# Altium schematic sheet gateway3.SchDoc
size A3; SheetNumber: 1; SheetTotal: 1
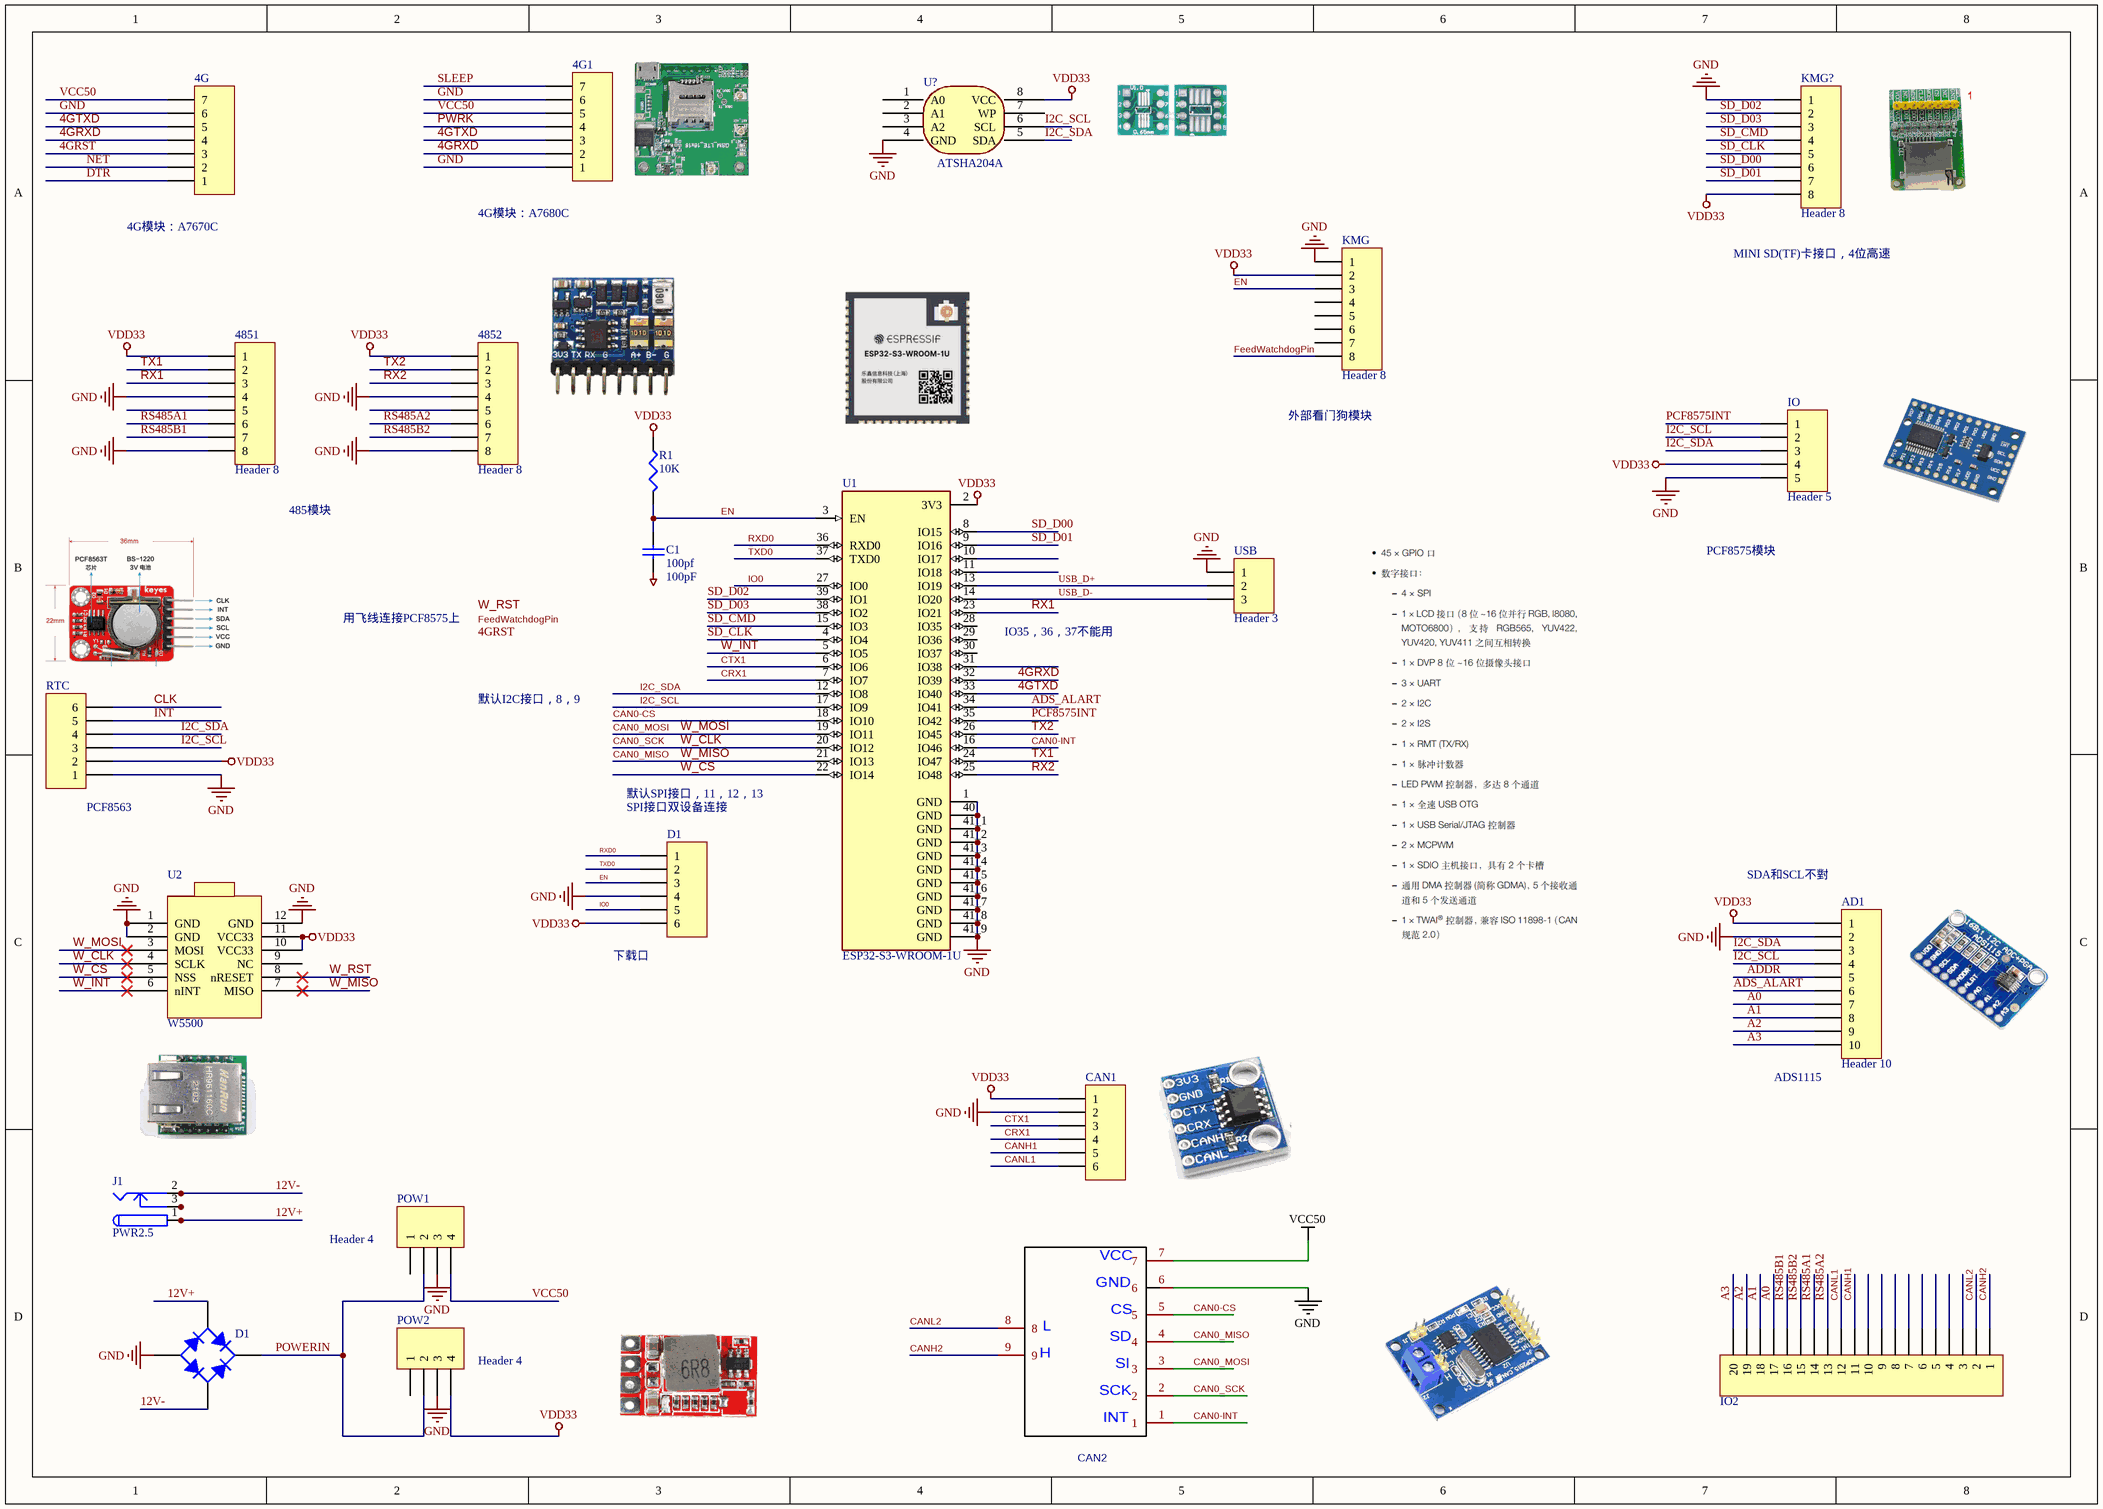
[diagram p0: gateway3.SchDoc]

## Parts
(Parts that share a designator on the sheet are numbered #1, #2 ... from top to bottom, then left to right.)
4G  DS1307模块  [DS1307]  (value not drawn)
4G1  DS1307模块  [DS1307]  (value not drawn)
4851  Header 8  [HDR1X8]
4852  Header 8  [HDR1X8]
AD1  Header 10  [HDR1X10]
C1  100pf  [0805]
CAN1  2.54DIP6  [HDR1X6]  (value not drawn)
CAN2  Can-BUs Module  [CAN模块]  (value not drawn)
D1#1  2.54DIP6  [HDR1X6]  (value not drawn)
D1#2  整流全桥-插  [D-38]  (value not drawn)
IO  Header 5  [HDR1X5]
IO2  Header 20  [HDR1X20]  (value not drawn)
J1  PWR2.5  [KLD-0202]
KMG  Header 8  [KMG]
KMG?  Header 8  [KMG]
POW1  Header 4  [HDR1X4]
POW2  Header 4  [HDR1X4]
R1  10K  [0805]
RTC  2.54DIP6  [HDR1X6]  (value not drawn)
U1  ESP32-S3-WROOM-1U  [ESP32-S3-WROOM-1U]
U2  W5500  [W5500]
U?  ATSHA204A  [DIP-8]
USB  Header 3  [HDR1X3]

## Nets
GND: 4G.6 4G1.1 4G1.6 4851.4 4851.8 4852.4 4852.8 AD1.2 C1.1 CAN1.2 CAN2.6 D1#1.4 D1#2.3(A) IO.5 KMG.1 KMG?.1 POW1.3 POW2.3 RTC.1 U1.1(GND) U1.40(GND) U1.41_1(GND) U1.41_2(GND) U1.41_3(GND) U1.41_4(GND) U1.41_5(GND) U1.41_6(GND) U1.41_7(GND) U1.41_8(GND) U1.41_9(GND) U2.1(GND) U2.2(GND) U2.12(GND) U?.4(GND) USB.1
VCC50: 4G.7 4G1.5 CAN2.7 POW1.4
VDD33: 4851.1 4852.1 AD1.1 CAN1.1 D1#1.6 IO.4 KMG.2 KMG?.8 POW2.4 R1.1 RTC.2 U1.2(3V3) U2.10(VCC33) U2.11(VCC33) U?.8(VCC)
4GRST: 4G.3
4GRXD: 4G.4 4G1.2 U1.32(IO39)
4GTXD: 4G.5 4G1.3 U1.33(IO40)
12V+: D1#2.4(C) J1.1 J1.1A J1.1B
12V-: D1#2.2(C) J1.2 J1.2A J1.2B
A0: AD1.7 IO2.17
A1: AD1.8 IO2.18
A2: AD1.9 IO2.19
A3: AD1.10 IO2.20
ADDR: AD1.5
ADS_ALART: AD1.6 U1.34(IO41)
CAN0-CS: CAN2.5 U1.18(IO10)
CAN0-INT: CAN2.1 U1.16(IO46)
CAN0_MISO: CAN2.4 U1.21(IO13) U2.7(MISO)  [also labelled W_MISO]
CAN0_MOSI: CAN2.3 U1.19(IO11) U2.3(MOSI)  [also labelled W_MOSI]
CAN0_SCK: CAN2.2 U1.20(IO12) U2.4(SCLK)  [also labelled W_CLK]
CANH1: CAN1.5 IO2.11
CANH2: CAN2.9 IO2.1
CANL1: CAN1.6 IO2.12
CANL2: CAN2.8 IO2.2
CLK: RTC.6
CRX1: CAN1.4 U1.7(IO7)
CTX1: CAN1.3 U1.6(IO6)
DTR: 4G.1
EN: C1.2 D1#1.3 KMG.3 R1.2 U1.3(EN)
FeedWatchdogPin: KMG.8
I2C_SCL: AD1.4 IO.2 RTC.3 U1.17(IO9) U?.6(SCL)
I2C_SDA: AD1.3 IO.3 RTC.4 U1.12(IO8) U?.5(SDA)
INT: RTC.5
IO0: D1#1.5 U1.27(IO0)
NET: 4G.2
PCF8575INT: IO.1 U1.35(IO42)
POWERIN: D1#2.1(K) POW1.2 POW2.2
PWRK: 4G1.4
RS485A1: 4851.6 IO2.14
RS485A2: 4852.6 IO2.13
RS485B1: 4851.7 IO2.16
RS485B2: 4852.7 IO2.15
RX1: 4851.3 U1.23(IO21)
RX2: 4852.3 U1.25(IO48)
RXD0: D1#1.1 U1.36(RXD0)
SD_CLK: KMG?.5 U1.4(IO4)
SD_CMD: KMG?.4 U1.15(IO3)
SD_D00: KMG?.6 U1.8(IO15)
SD_D01: KMG?.7 U1.9(IO16)
SD_D02: KMG?.2 U1.39(IO1)
SD_D03: KMG?.3 U1.38(IO2)
SLEEP: 4G1.7
TX1: 4851.2 U1.24(IO47)
TX2: 4852.2 U1.26(IO45)
TXD0: D1#1.2 U1.37(TXD0)
USB_D+: U1.13(IO19) USB.2
USB_D-: U1.14(IO20) USB.3
W_CS: U1.22(IO14) U2.5(NSS)
W_INT: U1.5(IO5) U2.6(nINT)
W_RST: U2.8(nRESET)
NetJ1_3: J1.3 J1.3A J1.3B

Not connected (* = marked no-connect by the designer): 4851 5; 4852 5; IO2 3 4 5 6 7 8 9 10; KMG 4 5 6 7; POW1 1; POW2 1; U1 10(IO17) 11(IO18) 28(IO35) 29(IO36) 30(IO37) 31(IO38); U2 9(NC); U? 1(A0) 2(A1) 3(A2) 7(WP)

## Notes on the sheet
- (near 4G) 4G模块：A7670C
- (near 4G1) 4G模块：A7680C
- MINI SD(TF)卡接口，4位高速
- 外部看门狗模块
- 485模块
- PCF8575模块
- 用飞线连接PCF8575上
- IO35，36，37不能用
- 默认I2C接口，8，9
- (near RTC) PCF8563
- 默认SPI接口，11，12，13
- (near D1#1) SPI接口双设备连接
- SDA和SCL不對
- (near D1#1) 下载口
- (near AD1) ADS1115
- Labels drawn without touching a wire or pin: 4GRST, FeedWatchdogPin, W_RST
- (in symbol Can-BUs Module) VCC; GND; CS; L; SD; H; SI; SCK; INT

## Library data of the parts
4G 4G1 = Header 7: Header, 7-Pin; LatestRevisionDate: 17-Jul-2002; LatestRevisionNote: Re-released for DXP Platform.; Publisher: Altium Limited
4851 4852 KMG KMG? = Header 8: Header, 8-Pin; LatestRevisionDate: 17-Jul-2002; LatestRevisionNote: Re-released for DXP Platform.; Publisher: Altium Limited
AD1 = Header 10: Header, 10-Pin; LatestRevisionDate: 17-Jul-2002; LatestRevisionNote: Re-released for DXP Platform.; Publisher: Altium Limited
C1 = Cap Semi: Capacitor (Semiconductor SIM Model); Published: 8-Jun-2000; LatestRevisionDate: 29-May-2009; LatestRevisionNote: IPC-7351 Footprint Added.; PackageReference: C1206; Publisher: Altium Limited; PackageDescription: Chip Capacitor; Value: 100pF
CAN1 D1#1 RTC = Header 6: Header, 6-Pin; LatestRevisionDate: 17-Jul-2002; LatestRevisionNote: Re-released for DXP Platform.; Publisher: Altium Limited
CAN2 = Can-BUs Module: Contributor: RPRCircuits; spicePre: U; spiceSymbolName: Can-BUs Module
D1#2 = Bridge1: Full Wave Diode Bridge; Published: 8-Jun-2000; LatestRevisionDate: 29-May-2009; LatestRevisionNote: Sch pins A & K swapped.; DatasheetVersion: E2732B; PackageReference: D-38; Publisher: Altium Limited; PackageDescription: Bridge Rectifier; 4 Terminals; Body 9.4 x 9.4 mm (typ); Pitch 5.08 mm
IO = Header 5: Header, 5-Pin; LatestRevisionDate: 17-Jul-2002; LatestRevisionNote: Re-released for DXP Platform.; Publisher: Altium Limited
IO2 = Header 20: Header, 20-Pin; LatestRevisionDate: 17-Jul-2002; LatestRevisionNote: Re-released for DXP Platform.; Publisher: Altium Limited
J1 = PWR2.5: Low Voltage Power Supply Connector; Published: 17-Dec-2003; DatasheetDocument: 09-May-2002; Publisher: Altium Limited; ComponentLink1Description: Manufacturer Link; ComponentLink1URL: http://domino.kycon.com/internet/Products.html
POW1 POW2 = Header 4: Header, 4-Pin; LatestRevisionDate: 17-Jul-2002; LatestRevisionNote: Re-released for DXP Platform.; Publisher: Altium Limited
R1 = Res3: Resistor; Published: 8-Jun-2000; LatestRevisionDate: 29-May-2009; LatestRevisionNote: IPC-7351 Footprint Added.; PackageReference: J1-0603; Publisher: Altium Limited; PackageDescription: Chip Resistor; Value: 10K
U1 = ESP32-S3-WROOM-1U: 2.4 GHz Wi-Fi (802.11 b/g/n) and Bluetooth 5 (LE) module; MF: Espressif Systems; SnapEDA_Link: https://www.snapeda.com/parts/ESP32-S3-WROOM-1U/Espressif+Systems/view-part/?ref=snap; Availability: Not in stock; Package: Package; Price: None; MP: ESP32-S3-WROOM-1U; Value: *; Check_prices: https://www.snapeda.com/parts/ESP32-S3-WROOM-1U/Espressif+Systems/view-part/?ref=eda
U? = 24CXX
USB = Header 3: Header, 3-Pin; LatestRevisionDate: 17-Jul-2002; LatestRevisionNote: Re-released for DXP Platform.; Publisher: Altium Limited